# EasyEDA Pro project ProProject_Avaota Pi A_2024-03-25.epro, board 点位 (continued)
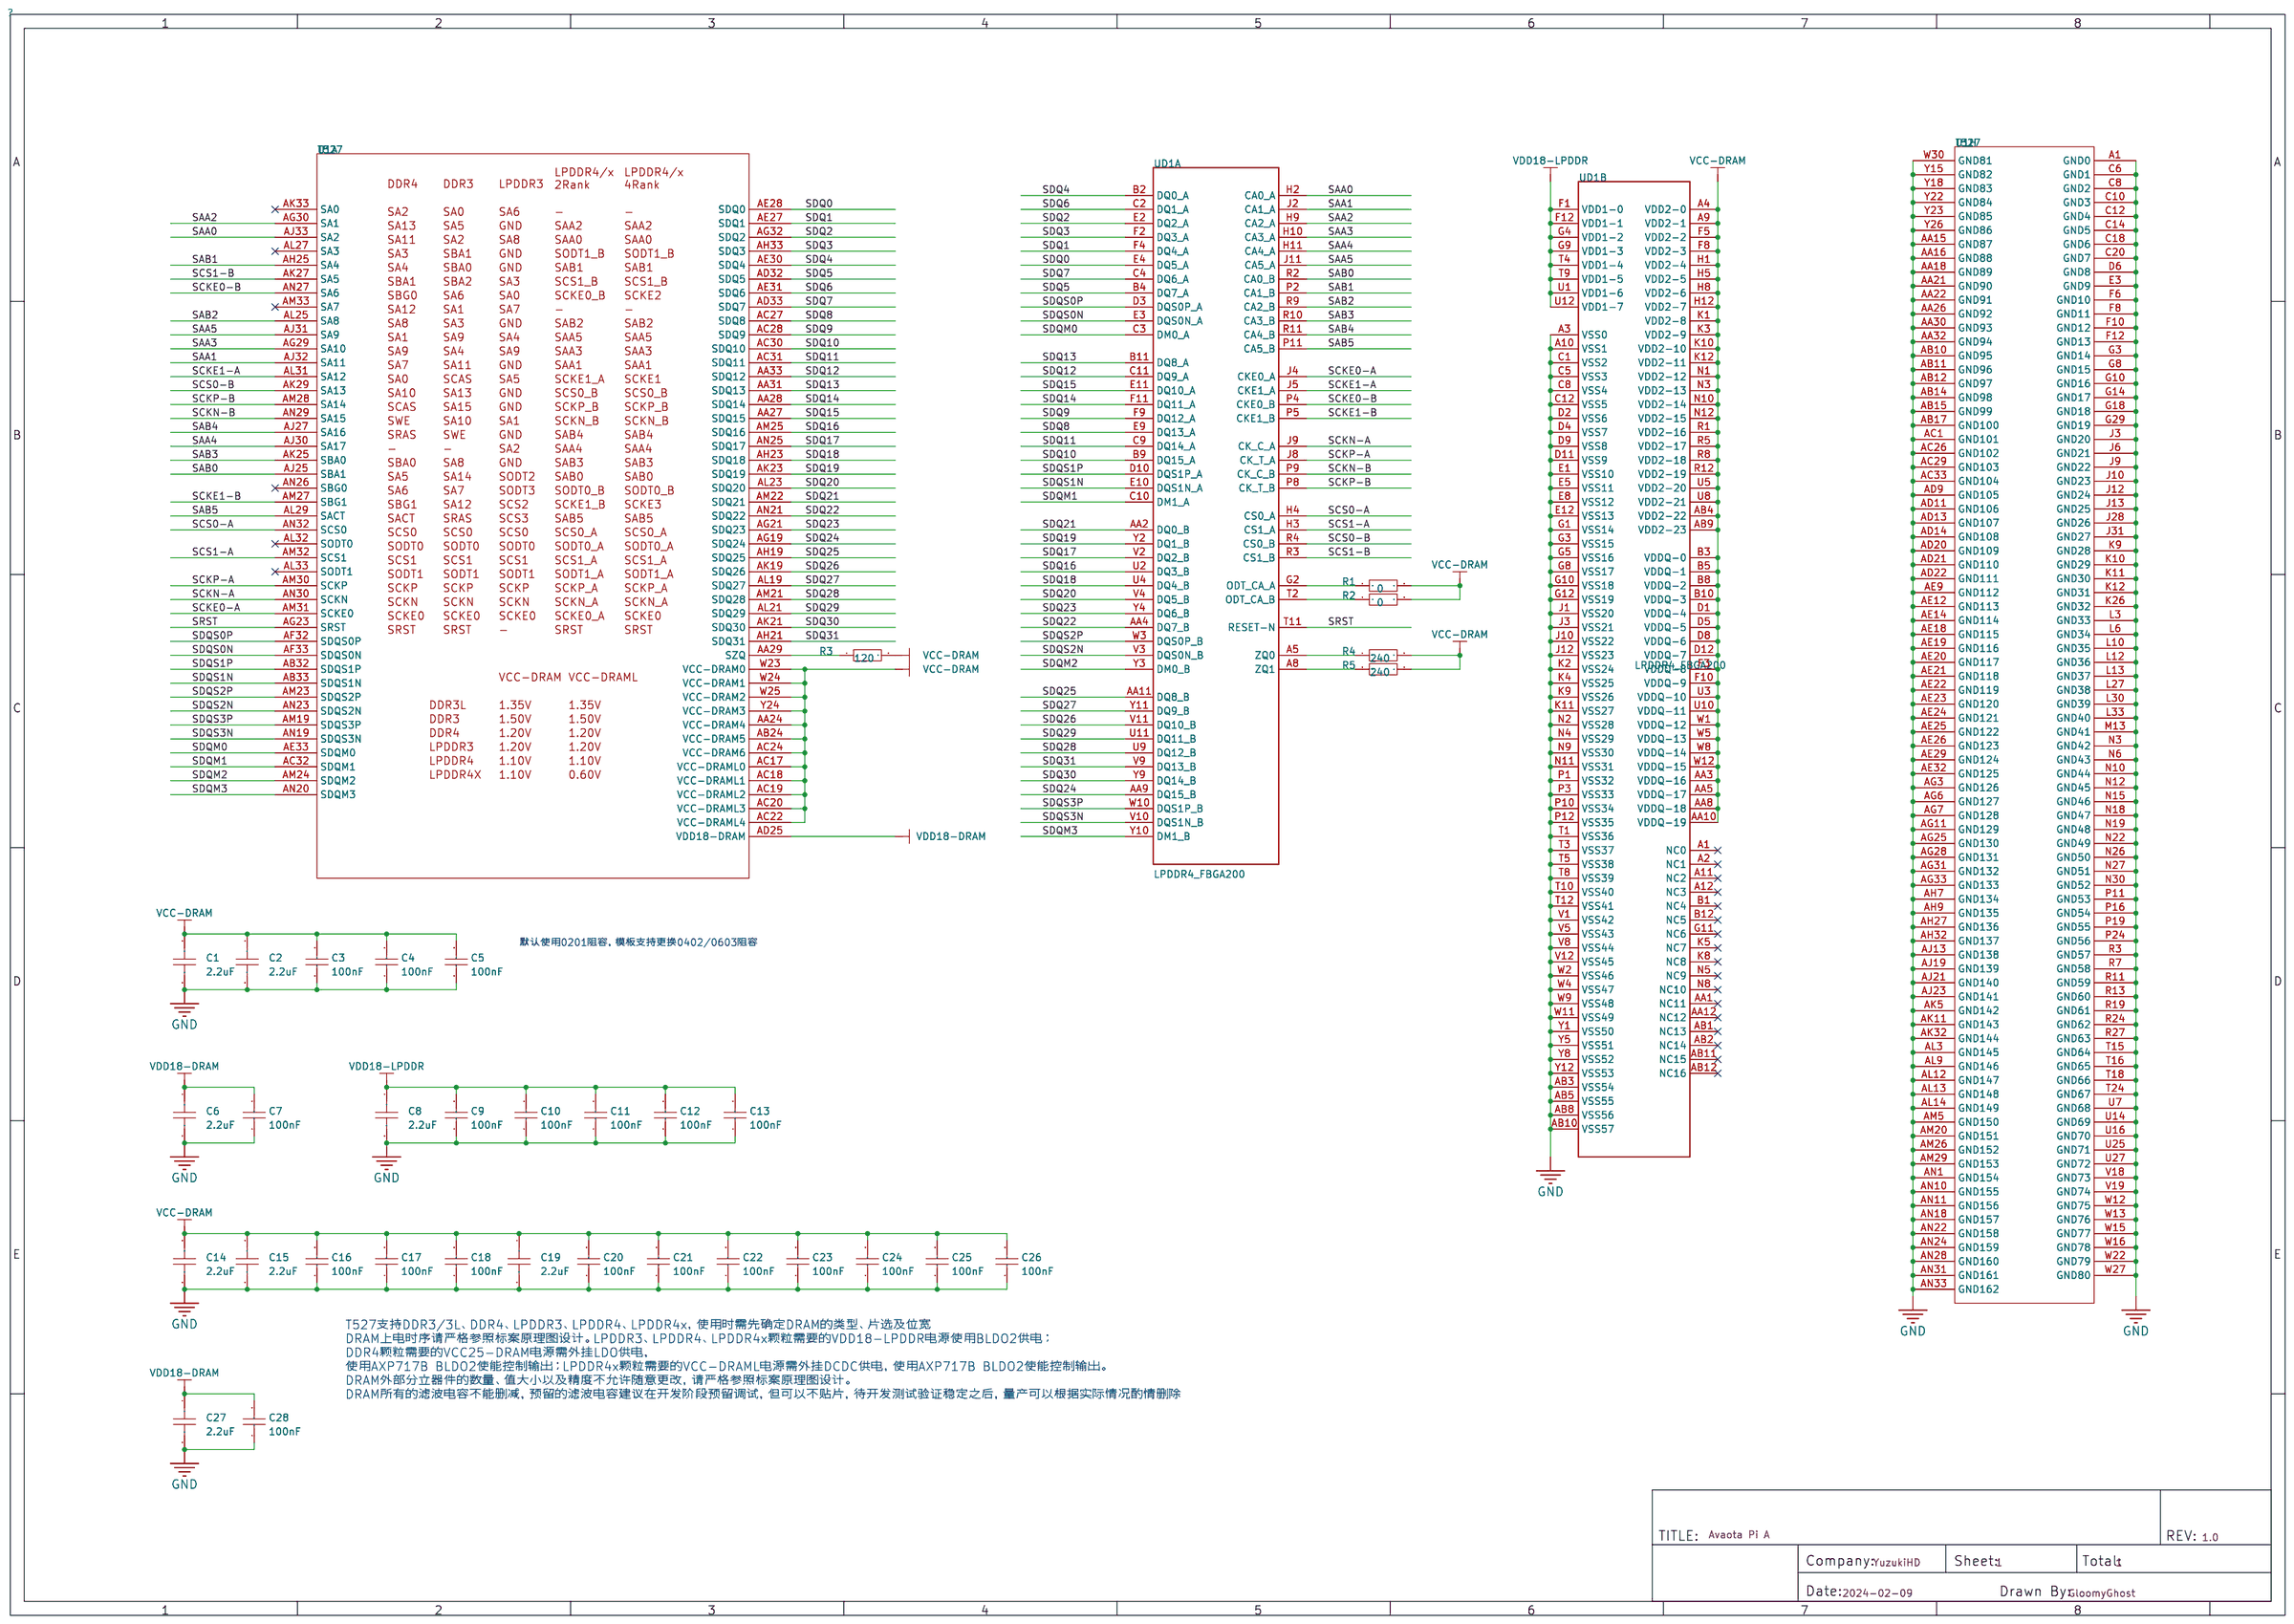
[diagram p0: schematic sheet]
## Routing (per net, layer and track width the routed paths; a pad name or vN(x,y) marks a point on that pad's centre or on a via; arc(x,y) is an arc through that point) (continued)
PE1: length 50.3
  Top Layer w0.076: 68.44,54.64 68.69,54.9 70.34,54.89 70.48,55.04
  Top Layer w0.102: v3(72.67,57.2) 72.64,57.2 70.48,55.04
  VCC w0.102: 33.3,70.69 33.32,70.69 37.49,66.52 52.5,66.52 57.05,61.98 61.29,61.98 64.8,58.47 66.19,58.47 67.18,57.48 71.12,57.48 71.22,57.58 72.29,57.58 v3(72.67,57.2)
PE2: length 52.9
  Top Layer w0.102: U14.E5 v3(67.95,54.65)
  Inner5 w0.102: 23.14,70.69 25.04,68.78 26.24,68.78 27.99,67.03 53.26,67.03 57.94,62.36 59.77,62.36 64.26,57.86 64.26,57.25 65.68,55.83 67.23,55.83 67.59,55.47 67.59,54.87 67.78,54.68 67.93,54.68 v3(67.95,54.65)
PE3: length 55.1
  Top Layer w0.102: U14.E4 v3(67.95,55.15)
  Inner5 w0.102: H1.16 25.03,72.58 24.88,72.58 24.46,72.16 24.46,69.75 25.04,69.16 26.39,69.16 28.19,67.36 53.47,67.36 58.14,62.69 60.02,62.69 64.59,58.12 64.59,57.33 65.76,56.16 67.44,56.16 67.95,55.65 v3(67.95,55.15)
PE4: length 56.9
  Top Layer w0.076: 70.43,57.76 70.24,57.76 69.18,56.71 69.18,56 69.08,55.89 68.84,55.89 68.69,55.75 68.69,55.39 68.44,55.14
  Top Layer w0.102: 70.43,57.76 70.69,57.76 71.5,58.57 v3(71.5,58.6)
  Inner5 w0.102: 25.68,70.69 25.68,70.46 28.45,67.69 53.64,67.69 57.53,63.81 59.51,63.81 65.71,57.61 70.51,57.61 v3(71.5,58.6)
PE5: length 52.3
  Top Layer w0.076: 70.08,55.5 69.97,55.4 69.19,55.4 68.94,55.14
  Top Layer w0.102: v3(71.58,57.2) 71.58,57 70.08,55.5
  VCC w0.102: H1.22 33.3,73.15 32.03,71.88 32.03,69.98 35.81,66.19 52.3,66.19 56.85,61.65 61.11,61.65 64.62,58.14 66.01,58.14 67.01,57.15 71.53,57.15 v3(71.58,57.2)
PE6: length 50.9
  Top Layer w0.076: 70.15,55.14 69.44,55.14
  Top Layer w0.102: v3(72.14,57.2) 72.14,57.12 70.15,55.14
  VCC w0.102: v3(72.14,57.2) 72.14,57.15 71.81,56.82 66.88,56.82 65.84,57.86 64.36,57.86 60.96,61.27 56.77,61.27 52.17,65.86 35.53,65.86 30.76,70.64 30.76,70.69
PE7: length 52
  Top Layer w0.102: v3(72.62,58.62) 71.96,57.96 71.78,57.96 71.22,57.4 71.22,57.05 69.82,55.65 U14.A2
  VCC w0.102: v3(72.62,58.62) 72.62,58.34 72.11,57.84 71.07,57.84 71.02,57.79 67.36,57.79 66.37,58.78 65,58.78 61.47,62.31 57.2,62.31 52.65,66.85 37.69,66.85 34.62,69.93 34.62,72.03 35.81,73.23 H1.24
PE8: length 46.5
  Top Layer w0.076: 70,56.24 69.65,55.89 69.31,55.89 69.07,55.64 68.94,55.64
  Top Layer w0.102: v3(72.06,58.6) 72.06,58.51 71.82,58.27 71.68,58.27 70.89,57.48 70.89,57.12 70,56.24
  VCC w0.102: 35.84,70.69 35.84,70.23 38.81,67.26 52.81,67.26 57.38,62.69 61.59,62.69 65.2,59.08 66.5,59.08 67.49,58.09 71.55,58.09 v3(72.06,58.6)
PE9: length 56.6
  Top Layer w0.102: v3(70.94,58.6) 70.94,58.52 70.46,58.04 70.21,58.04 68.94,56.77 68.94,56.14
  Inner5 w0.102: v3(70.94,58.6) 70.23,57.89 66.07,57.89 59.72,64.24 57.63,64.24 53.85,68.02 28.63,68.02 26.97,69.67 26.97,71.93 28.22,73.18 H1.18
PE10: length 39.4
  Top Layer w0.076: 68.83,56.94 68.69,56.8 68.69,56.01 68.44,55.76 68.44,55.64
  Top Layer w0.115: 68.83,56.94 68.83,57.22 69.91,58.29 70.07,58.29 70.37,58.6 v3(70.41,58.6)
  Inner5 w0.102: 40.92,70.69 43.26,68.35 54.81,68.35 58.06,65.1 59.49,65.1 60.22,64.36 61.32,64.36 61.52,64.16 61.52,62.97 66.32,58.17 69.98,58.17 v3(70.41,58.6)
PE11: length 59.8
  Top Layer w0.102: v3(65.95,53.15) U14.J7
  Inner5 w0.102: 15.52,70.69 18.52,67.69 25.81,67.69 27.48,66.01 52.58,66.01 57.2,61.39 59.23,61.39 60.55,60.07 60.55,58.37 61.37,57.56 62.59,57.56 65.35,54.79 65.35,53.7 65.91,53.15 v3(65.95,53.15)
PE12: length 44.7
  Top Layer w0.102: v3(69.8,58.62) 68.5,57.33 68.5,56.21 U14.C1
  VCC w0.102: v3(69.8,58.62) 69.57,58.39 67.72,58.39 66.67,59.44 65.41,59.44 61.77,63.07 59.72,63.07 58.95,63.83 56.79,63.83 52.96,67.67 38.86,67.67 37.13,69.39 37.13,71.98 H1.26
PE13: length 55.2
  Top Layer w0.254: U14.G6 v3(66.95,54.15)
  Inner5 w0.102: 20.6,70.69 20.6,70.56 23.09,68.07 25.96,68.07 27.69,66.35 52.78,66.35 57.45,61.67 59.44,61.67 60.86,60.25 60.86,58.57 61.54,57.89 62.69,57.89 65.48,55.09 66.09,55.09 66.42,54.76 66.42,54.31 66.57,54.15 v3(66.95,54.15)
PE14: length 61.7
  Top Layer w0.102: v3(64.95,53.15) U14.L7
  Inner5 w0.102: v3(64.95,53.15) 64.57,53.53 64.57,54.08 64.31,54.33 64.31,55.42 62.48,57.25 61.16,57.25 60.25,58.17 60.25,59.89 59.06,61.09 57.01,61.09 52.41,65.68 27.25,65.68 25.63,67.31 16.36,67.31 12.98,70.69
PE15: length 63.1
  Top Layer w0.102: v3(63.95,53.15) U14.N7
  Inner5 w0.102: 10.44,70.69 10.44,70.36 13.84,66.95 25.43,66.95 27,65.38 45.03,65.38 49.63,60.78 55.68,60.78 56.29,60.17 57.73,60.17 61.52,56.39 62.86,56.39 63.96,55.3 63.96,54.28 64.31,53.92 64.31,53.34 64.12,53.15 v3(63.95,53.15)
PGAOUT0: length 6.5
  Top Layer w0.152: v3(61.95,52.65) 61.45,52.65 U14.U8
  Bottom Layer w0.076: v3(61.95,52.65) 62.56,53.26
  Bottom Layer w0.152: 62.56,53.26 62.59,53.29 62.59,55.98 62.18,56.39 60.86,56.39 60.71,56.24 R26.1
PGAOUT1: length 4
  Bottom Layer w0.152: R27.1 61.76,55.21 61.44,54.89 v3(61.44,51.65)
PHYRSTB0: length 46.9
  Top Layer w0.127: U14.D16 v3(67.94,49.15) ; U12.12 v3(70.39,21.03) 70.93,21.03 R90.2
  内层2 w0.102: v3(67.94,49.15) 69.32,49.15 70.05,49.89 72.42,49.89 72.8,50.27 74.63,50.27 74.88,50.01 76.45,50.01 79.45,47.02 79.45,29.46 73.58,23.6 73.58,21.64 72.97,21.03 72.01,21.03 72.01,21.03 v3(70.39,21.03)
PHYRSTB1: length 71.3
  Top Layer w0.102: v3(89.53,51.23) 89.53,51.26 88.62,52.17 88.47,52.17 88.04,52.6 88.04,57.99 83.85,62.18 68.41,62.18 65.94,59.71 65.94,57.3 65.58,56.95 65.58,56.29 U14.J1
  Top Layer w0.152: U13.12 88.99,20.89 R108.2
  内层2 w0.102: v3(88.65,20.8) 89.31,20.8 90.14,21.64 90.14,22.5 89.99,22.66 89.99,23.14 90.27,23.42 90.6,23.42 91.52,24.33 91.52,25.25 90.07,26.7 90.07,28.19 89.28,28.98 89.28,50.98 v3(89.53,51.23)
PMU-SCK: length 72.3
  Top Layer w0.102: U14.AN6 53.34,53.75 52.53,53.75 51.49,54.79 51.49,55.6 50.39,56.69 v1(37.36,56.69)
  Top Layer w0.152: R11.2 5.18,49.05 v3(5.16,49.07) 5.31,49.23 U4.52 ; v3(12.32,45.31) 12.75,44.88 13.03,44.88 13.13,44.98 14.78,44.98 15.09,44.68 15.09,44.06 U5.6
  Bottom Layer w0.102: v1(37.36,56.69) 36.55,56.69 35.86,56.01 14.4,56.01 12.47,54.08 12.47,50.06 11.1,48.69 6.26,48.69 5.65,49.3 5.38,49.3 v3(5.16,49.07) 5.16,48.9 5.82,48.23 5.82,46.05 6.93,44.93 11.94,44.93 v3(12.32,45.31)
PMU-SDA: length 75.2
  Top Layer w0.076: 53.43,54.14 53.44,54.14
  Top Layer w0.102: v1(36.75,57.07) 37.57,57.07 37.72,56.92 50.52,56.92 51.71,55.73 51.71,54.86 52.63,53.95 53.25,53.95 53.43,54.14 U14.AN5
  Top Layer w0.152: v3(12.85,45.31) 12.9,45.26 14.88,45.26 15.45,44.7 U5.5 ; R12.2 5.71,48.16 5.56,48.31 5.56,48.77 5.69,48.9 6.12,48.9 6.2,48.97 6.2,49.56 6.12,49.63 5.15,49.63 v3(5.13,49.61)
  Bottom Layer w0.102: v1(36.75,57.07) 36.42,57.07 35.66,56.31 13.51,56.31 12.24,55.04 12.24,50.24 10.97,48.97 6.35,48.97 5.71,49.61 v3(5.13,49.61) 4.8,49.28 4.8,48.92 5.56,48.16 5.56,45.92 6.78,44.7 12.24,44.7 v3(12.85,45.31)
PS: length 30.3
  Top Layer w0.203: C17.1 12.75,51.77 12.49,52.03 U4.20 11.59,52.02 v3(11.05,52.02) ; U4.47 6.32,51.23 v3(6.38,51.28) ; C12.1 12.62,54.51 12.14,54.03 U4.25 11.6,54.03 v3(11.05,54.03) ; 5.73,52.43 6.32,52.43 v3(6.38,52.38) ; v3(6.38,52.86) 6.35,52.83 U4.43 ; v3(6.38,50.81) 6.36,50.83 U4.48 ; U5.20 17.66,44.16 v3(17.65,44.17) ; U5.2 16.65,44.96 v3(16.79,45.1) ; U5.17 18.04,42.61 18.19,42.47 v3(18.19,41.81) ; C55.1 12.78,48.97 12.4,49.35 12.4,49.56 11.92,50.03 U4.15 11.04,50.03 v3(11.02,50.01) ; v3(9.32,54.15) 9.26,54.21 U4.31 9.26,54.95 v3(8.99,55.22) 8.86,55.09 U4.32 8.86,54.23 v3(8.79,54.15)
  Top Layer w0.254: U4.9 v3(9.66,49.43)
  Top Layer w0.381: C70.2 17.91,45.03 17.91,44.42 v3(17.65,44.17)
  Top Layer w0.406: C284.2 17.84,39.92 18.19,40.26 v3(18.19,41.81)
  Top Layer w0.508: C284.2 C283.2
  Bottom Layer w0.102: v3(11.02,50.01) C46.1
  Bottom Layer w0.381: v3(11.05,54.03) 11.1,53.98 11.1,53.31 ; v3(9.66,49.43) 9.67,49.43 C30.1 ; v3(11.05,52.02) 11.1,52.07 11.1,52.43
  Bottom Layer w0.508: 11.05,51.35 v3(11.05,52.02) ; v3(9.32,54.15) 9.32,55.28 C285.2 ; 5.89,52.38 v3(6.38,52.38) ; v3(6.38,51.28) 6.02,51.28 C79.2 ; v3(6.38,50.81) 6.13,51.05 C79.2 ; v3(8.79,54.15) 8.79,55.13 C286.2 ; C79.2 C29.1 5.79,52.83 5.82,52.86 v3(6.38,52.86) 6.5,52.98 C26.1
PWRON: length 21.7
  Top Layer w0.152: C11.1 8.46,48.88 U4.6 ; v1(4.32,63.53) 4.32,64.52 3.49,65.34 C97.2
  Top Layer w0.203: U4.6 8.46,49.31 v3(8.66,49.5)
  Top Layer w0.254: C97.2 R23.2
  Inner5 w0.152: v3(8.66,49.5) 7.9,50.27 7.9,53.29 7.57,53.62 7.01,53.62 3.91,56.72 3.91,63.12 v1(4.32,63.53)
RF: length 3.7
  Top Layer w0.127: R72.1 C244.2 15.68,64.17 15.72,64.2
RGMII0-CLKIN: length 47.9
  Top Layer w0.076: 70.56,48.18 70.33,48.18 70.26,48.11 69.99,48.11 69.78,47.9 68.69,47.89 68.44,48.14
  Top Layer w0.102: v3(74.04,49.28) 72.95,48.18 70.56,48.18
  Top Layer w0.127: U12.35 v3(63.35,22.63)
  内层2 w0.102: v3(63.35,22.63) 63.52,22.45 71.7,22.45 72.31,23.06 72.31,24 78.51,30.2 78.51,46.51 75.84,49.17 74.14,49.17 v3(74.04,49.28)
RGMII0-MDC: length 43.5
  Top Layer w0.076: 69.9,48.53 69.9,48.54 ; 69.9,48.53 69.67,48.3 69.14,48.3 69.04,48.39 68.69,48.39 68.44,48.64
  Top Layer w0.102: v3(72.85,49.3) 72.24,48.69 70.04,48.69 69.88,48.51 ; v3(72.42,21.49) 72.35,21.43 U12.13
  内层2 w0.102: v3(72.85,49.3) 73.2,49.66 74.24,49.66 74.47,49.43 76.05,49.43 78.82,46.66 78.82,29.97 72.72,23.88 72.72,21.79 v3(72.42,21.49)
RGMII0-MDIO: length 44.1
  Top Layer w0.076: 71.98,49 71.91,48.92 69.22,48.92 U14.B16
  Top Layer w0.102: 71.98,49 v3(72.29,49.3)
  Top Layer w0.127: U12.14 70.91,21.83 R83.2 70.93,21.98 71.23,22.28 72.26,22.28 72.72,21.82 v3(73.18,21.82)
  内层2 w0.102: v3(72.29,49.3) 72.92,49.94 74.47,49.94 74.7,49.71 76.25,49.71 79.12,46.84 79.12,29.69 73.1,23.67 73.1,21.9 v3(73.18,21.82)
RGMII0-RXCK: length 42.7
  Top Layer w0.076: 68.94,49.64 69.1,49.64 69.34,49.4 69.54,49.4 69.84,49.7 70.29,49.7 v3(70.66,49.33)
  Top Layer w0.127: v3(66.19,26.76) 66.19,26.54 66,26.35 U12.27
  内层2 w0.102: v3(66.19,26.76) 66.42,26.53 66.42,25.2 67.39,24.23 70.51,24.23 77.27,30.99 77.27,45.92 75.16,48.03 71.96,48.03 v3(70.66,49.33)
RGMII0-RXCTL: length 42.2
  Top Layer w0.127: U14.D18 v3(67.94,48.15) ; v3(66.75,26.76) 66.75,26.49 66.4,26.14 U12.26
  内层2 w0.102: v3(66.75,26.76) 66.75,25.3 67.49,24.56 70.28,24.56 76.91,31.19 76.91,45.87 75.11,47.68 71.75,47.68 70.79,48.64 68.43,48.64 v3(67.94,48.15)
RGMII0-RXD0: length 41.5
  Top Layer w0.127: U14.E18 v3(67.44,48.15) ; U12.25 66.8,25.96 67.34,26.49 v3(67.34,26.76)
  内层2 w0.102: v3(67.44,48.15) 67.44,47.93 67.59,47.78 68.1,47.78 68.61,48.29 70.69,48.29 71.6,47.37 74.93,47.37 76.58,45.72 76.58,31.39 70.03,24.84 67.64,24.84 67.11,25.37 67.11,26.39 67.34,26.62 v3(67.34,26.76)
RGMII0-RXD1: length 40.5
  Top Layer w0.127: U12.24 67.2,25.8 67.96,26.56 v3(67.96,26.76) ; U14.F18 v3(66.94,48.15)
  内层2 w0.102: v3(66.94,48.15) 66.94,48.02 67.42,47.54 68.34,47.54 68.76,47.96 70.56,47.96 71.48,47.04 74.78,47.04 76.25,45.57 76.25,31.62 69.75,25.12 67.87,25.12 67.46,25.53 67.46,26.26 v3(67.96,26.76)
RGMII0-RXD2: length 48.8
  Top Layer w0.127: v3(68.55,26.76) 68.55,26.59 67.6,25.64 67.6,24.93 ; U14.D14 v3(67.94,50.15)
  内层4 w0.102: v3(67.94,50.15) 68.06,50.15 70.03,48.18 78.21,48.18 80.57,45.82 80.57,28.8 76.78,25.02 69.77,25.02 68.55,26.24 v3(68.55,26.76)
RGMII0-RXD3: length 48.1
  Top Layer w0.127: v3(67.44,50.15) U14.E14 ; U12.22 68,25.48 69.19,26.67 v3(69.19,26.76)
  内层4 w0.102: v3(69.19,26.76) 68.94,26.5 68.94,26.29 69.93,25.3 76.68,25.3 80.29,28.91 80.29,45.64 78.03,47.9 69.9,47.9 68.05,49.76 67.84,49.76 v3(67.44,50.15)
RGMII0-TXCK: length 50.4
  Top Layer w0.102: U14.G12 66.42,50.62 v3(66.42,50.17) ; v3(76.84,23.93) 76.45,24.31 75.26,24.31 74.7,23.75 73.03,23.75 72.29,24.49 69.82,24.49 69.57,24.23 U12.20
  内层2 w0.076: v3(66.42,50.17) 66.78,50.52 68.07,50.52 68.43,50.17 68.94,50.17 69.04,50.27
  内层2 w0.102: 69.04,50.27 69.49,50.72 71.91,50.72 72.42,51.23 75.16,51.23 75.41,50.98 76.99,50.98 80.44,47.52 80.44,28.78 76.84,25.17 v3(76.84,23.93)
RGMII0-TXCTL: length 48.6
  Top Layer w0.102: v3(76.2,23.9) 75.31,23.9 74.83,23.42 72.85,23.42 72.09,24.18 69.98,24.18 69.62,23.83 U12.19
  Top Layer w0.127: U14.F14 v3(66.94,50.15)
  内层2 w0.102: v3(66.94,50.15) 67.36,49.73 69.01,49.73 69.7,50.42 72.03,50.42 72.52,50.9 74.96,50.9 75.21,50.65 76.81,50.65 80.11,47.35 80.11,29.03 76.45,25.37 76.45,24.16 v3(76.2,23.9)
RGMII0-TXD0: length 47.5
  Top Layer w0.102: U12.18 69.76,23.43 70.16,23.83 71.98,23.83 72.75,23.06 75.03,23.06 75.46,23.5 v3(75.62,23.5)
  Top Layer w0.127: U14.E16 v3(67.44,49.15)
  内层2 w0.102: v3(75.62,23.5) 75.62,23.9 76.1,24.38 76.1,25.55 79.78,29.24 79.78,47.19 76.63,50.34 75.03,50.34 74.78,50.6 72.62,50.6 72.19,50.17 69.9,50.17 69.24,49.5 67.79,49.5 v3(67.44,49.15)
RGMII0-TXD1: length 39.9
  Top Layer w0.076: 68.94,48.14 69.02,48.07 69.71,48.07 70.08,48.44 70.43,48.44
  Top Layer w0.102: v3(73.46,49.3) 72.59,48.44 70.43,48.44 ; v3(70.16,23.11) 70.07,23.03 U12.17
  内层2 w0.102: v3(73.46,49.3) 73.86,48.9 75.64,48.9 78.23,46.3 78.23,30.4 71.96,24.13 71.96,23.17 71.65,22.86 70.41,22.86 v3(70.16,23.11)
RGMII0-TXD2: length 37.5
  Top Layer w0.076: 69.44,49.64 69.71,49.91 70.36,49.91 70.62,49.66 70.87,49.66 v3(71.2,49.33)
  Top Layer w0.102: U12.16 70.25,22.63 v3(70.97,23.34)
  内层2 w0.102: v3(71.2,49.33) 72.19,48.34 75.29,48.34 77.6,46.03 77.6,30.79 71.2,24.38 71.2,23.57 v3(70.97,23.34)
RGMII0-TXD3: length 39
  Top Layer w0.102: v3(71.55,23.34) 71.55,23.27 70.51,22.23 U12.15 ; v3(71.73,49.33) 71.2,49.86 70.76,49.86 70.51,50.11 68.97,50.11 U14.B13
  内层2 w0.102: v3(71.73,49.33) 72.44,48.62 75.44,48.62 77.93,46.13 77.93,30.61 71.55,24.23 v3(71.55,23.34)
RGMII1-CLKIN: length 59
  Top Layer w0.076: 67.44,55.64 67.7,55.91 67.7,57.71 68.3,58.3 68.3,58.32
  Top Layer w0.102: 68.3,58.32 69.8,59.82 81.64,59.82 84.07,57.38 84.07,55.32 84.28,55.12 84.28,54.36 83.97,54.05 83.49,54.05 v3(83.16,53.72)
  Top Layer w0.152: U13.35 v3(81.53,22.49)
  内层2 w0.102: v3(83.16,53.72) 83.16,52.12 83.74,51.54 83.74,48.34 84.56,47.52 84.56,27.89 83.87,27.2 83.87,26.44 84.25,26.06 84.25,25.21 v3(81.53,22.49)
RGMII1-MDC: length 71.2
  Top Layer w0.076: 65.94,55.64 66.01,55.71 66.01,56.4 66.27,56.66 66.27,58.01 66.18,58.09 66.18,58.49 66.24,58.56
  Top Layer w0.102: v3(88.95,51.23) 88.52,51.66 88.44,51.66 87.68,52.43 87.68,57.79 83.59,61.87 68.63,61.87 66.25,59.5 66.25,58.55 ; v3(90.45,22.94) 90.12,22.61 90.12,21.64 89.77,21.29 U13.13
  内层2 w0.102: v3(90.45,22.94) 90.7,22.94 91.9,24.13 91.9,25.43 90.37,26.95 90.37,28.35 89.61,29.11 89.61,50.75 89.92,51.05 89.92,51.38 89.66,51.64 89.41,51.64 89.26,51.49 89.2,51.49 v3(88.95,51.23)
RGMII1-MDIO: length 68
  Top Layer w0.076: 65.94,55.14 66.19,55.4 66.19,56.32 66.43,56.56 66.43,58.33 66.51,58.41 66.51,58.98 66.55,59.01 ; 66.55,59.01 66.55,59.15
  Top Layer w0.102: R101.2 89.04,22.19 v3(89.33,22.48) ; v3(88.37,51.23) 87.33,52.27 87.33,57.58 83.34,61.57 68.86,61.57 66.55,59.27 66.55,59.15
  Top Layer w0.152: R101.2 89.04,21.69 U13.14
  内层2 w0.102: v3(89.33,22.48) 89.71,22.86 89.71,23.42 90.04,23.75 90.37,23.75 91.11,24.49 91.11,25.12 89.66,26.57 89.66,28.14 88.9,28.91 88.9,50.7 v3(88.37,51.23)
RGMII1-RXCK: length 60.2
  Top Layer w0.102: U14.J5 v3(65.95,54.15)
  Top Layer w0.152: v3(84.28,26.61) 84.16,26.49 84.16,24.79
  内层2 w0.102: v3(84.28,26.61) 84.28,27.03 84.88,27.63 84.88,47.7 84.1,48.49 84.1,51.74 83.57,52.27 83.57,53.87 82.98,54.46 82.98,54.97 83.36,55.35 83.74,55.35 84.33,55.93 84.33,57.63 82.17,59.79 68.53,59.79 67.56,58.83 67.56,53.87 67.26,53.57 66.7,53.57 66.12,54.15 v3(65.95,54.15)
RGMII1-RXCTL: length 54.5
  Top Layer w0.076: 67.75,58.05 67.44,57.74 67.44,56.54
  Top Layer w0.102: 67.76,58.05 67.76,58.15 69.7,60.1 81.91,60.1 84.45,57.56 84.45,55.52 84.63,55.35 84.63,54.25 84.02,53.65 v3(84.02,52.48) ; 67.44,56.15 67.44,56.54
  Top Layer w0.152: v3(84.81,26.61) 84.81,26.34 84.56,26.09 84.56,24.79
  内层2 w0.102: v3(84.81,26.61) 84.81,27.08 85.19,27.46 85.19,47.93 84.48,48.64 84.48,52.02 v3(84.02,52.48)
RGMII1-RXD0: length 57.5
  Top Layer w0.076: 68.4,57.63 68.19,57.42 68.19,55.9 67.94,55.64
  Top Layer w0.102: 68.4,57.63 68.4,57.71 69.9,59.21 76.64,59.21 76.74,59.11 76.74,58.85 76.84,58.75 77.02,58.75 77.12,58.85 77.12,59.11 77.22,59.21 77.4,59.21 77.5,59.11 77.5,58.85 77.6,58.75 77.78,58.75 77.88,58.85 77.88,59.11 77.98,59.21 78.16,59.21 78.26,59.11 78.26,58.85 78.36,58.75 78.54,58.75 78.64,58.85 78.64,59.11 78.74,59.21 78.92,59.21 79.02,59.11 79.02,58.85 79.12,58.75 79.3,58.75 79.4,58.85 79.4,59.11 79.51,59.21 79.68,59.21 79.79,59.11 79.79,58.85 79.89,58.75 80.06,58.75 80.17,58.85 80.17,59.11 80.27,59.21 80.45,59.21 80.55,59.11 80.55,58.85 80.65,58.75 80.83,58.75 80.93,58.85 80.93,59.11 81.03,59.21 81.23,59.21 83.39,57.05 83.39,56.44 83.29,56.33 83.03,56.33 82.93,56.23 82.93,56.05 83.03,55.95 83.29,55.95 83.39,55.85 83.39,55.67 83.29,55.57 83.03,55.57 82.93,55.47 82.93,55.29 83.03,55.19 83.29,55.19 83.39,55.09 v3(83.39,54.64)
  Top Layer w0.152: 84.96,24.79 84.96,25.9 85.37,26.31 v3(85.37,26.61)
  内层2 w0.102: v3(83.39,54.64) 83.41,54.64 83.92,54.13 83.92,53.19 84.81,52.3 84.81,48.87 85.5,48.18 85.5,27.28 85.37,27.15 v3(85.37,26.61)
RGMII1-RXD1: length 52.5
  Top Layer w0.076: 67.94,56.14 68.01,56.22 68.01,57.58
  Top Layer w0.102: 68.01,57.58 68.01,57.64 69.89,59.51 81.41,59.51 83.72,57.2 83.72,54.89 v3(83.92,54.69)
  Top Layer w0.152: 85.36,24.79 85.36,25.79 85.95,26.39 v3(85.95,26.61)
  内层2 w0.102: v3(85.95,26.61) 85.95,27.18 85.83,27.31 85.83,48.41 85.14,49.1 85.14,52.5 84.25,53.39 84.25,54.36 v3(83.92,54.69)
RGMII1-RXD2: length 60.4
  Top Layer w0.102: v3(65.95,54.65) U14.J4
  Top Layer w0.152: v3(86.51,26.61) 86.51,26.54 85.76,25.79 85.76,24.79
  内层2 w0.102: v3(65.95,54.65) 66.8,53.8 67.11,53.8 67.31,54 67.31,55.7 67.21,55.8 67.21,59.03 68.33,60.15 82.32,60.15 84.66,57.81 84.66,53.49 85.47,52.68 85.47,49.25 86.13,48.59 86.13,27.48 86.51,27.1 v3(86.51,26.61)
RGMII1-RXD3: length 59.7
  Top Layer w0.102: U14.G5 v3(66.95,54.65)
  Top Layer w0.152: v3(87.07,26.61) 87.07,26.54 86.16,25.63 86.16,24.79
  内层2 w0.102: v3(87.07,26.61) 87.07,27.05 86.46,27.66 86.46,48.84 85.85,49.45 85.85,52.86 85.04,53.67 85.04,57.96 82.47,60.53 68.17,60.53 66.9,59.26 66.9,55.65 66.57,55.32 66.57,55.03 v3(66.95,54.65)
RGMII1-TXCK: length 60.4
  Top Layer w0.076: 66.44,56.14 66.44,56.25 66.6,56.41 66.6,58.15 66.77,58.32 66.77,58.46
  Top Layer w0.102: 66.77,58.46 66.77,59 69.03,61.27 83.03,61.27 86.94,57.35 86.94,53.95 v3(86.18,53.19) ; 87.26,24.09 87.59,24.09 87.76,24.26 v3(87.76,25.1)
  内层2 w0.102: v3(86.18,53.19) 86.23,53.14 86.23,49.58 86.82,49 86.82,27.91 87.5,27.23 87.5,25.35 v3(87.76,25.1)
RGMII1-TXCTL: length 60.4
  Top Layer w0.076: 67.03,58.52 67.03,58.29 66.78,58.04 66.78,56.32 66.69,56.23 66.69,55.89 66.44,55.64
  Top Layer w0.102: U13.19 87.72,23.69 88.32,24.28 v3(88.32,25.1) ; v3(86.51,54.15) 86.47,54.15 86.59,54.27 86.59,57.12 82.75,60.96 69.21,60.96 67.03,58.78 67.03,58.52
  内层2 w0.102: v3(86.51,54.15) 86.51,53.52 86.61,53.42 86.61,49.78 87.15,49.25 87.15,28.07 87.83,27.38 87.83,25.58 v3(88.32,25.1)
RGMII1-TXD0: length 59.9
  Top Layer w0.076: 67.53,58.36 67.53,58.08 67.24,57.78 67.24,56.57 67.19,56.52 67.19,55.89 66.94,55.64
  Top Layer w0.102: 67.52,58.34 69.58,60.4 82.17,60.4 84.81,57.76 84.81,55.88 85.39,55.3 v3(85.42,55.3) ; v3(88.87,25.1) 88.87,24.31 87.86,23.29 87.26,23.29
  内层2 w0.102: v3(85.42,55.3) 85.72,54.99 86.56,54.99 86.97,54.58 86.97,49.96 87.5,49.43 87.5,28.22 88.16,27.56 88.16,25.81 v3(88.87,25.1)
RGMII1-TXD1: length 61.1
  Top Layer w0.076: 66.94,56.14 67.01,56.22 67.01,57.94 67.28,58.21 67.28,58.56 67.3,58.57
  Top Layer w0.102: v3(89.46,25.1) 89.46,24.34 88.01,22.89 U13.17 ; 67.3,58.57 69.4,60.68 82.45,60.68 85.19,57.94 85.19,56.08 85.55,55.73 85.93,55.73 v3(86.13,55.52)
  内层2 w0.102: v3(86.13,55.52) 86.39,55.27 86.77,55.27 87.33,54.71 87.33,50.19 87.86,49.66 87.86,28.37 88.52,27.71 88.52,26.04 v3(89.46,25.1)
RGMII1-TXD2: length 66.4
  Top Layer w0.102: v3(90.02,25.1) 90.02,24.38 88.12,22.49 U13.16 ; v3(64.95,54.15) U14.L5
  内层2 w0.102: v3(90.02,25.1) 88.9,26.21 88.9,27.86 88.19,28.58 88.19,49.89 87.68,50.39 87.68,54.89 86.54,56.03 86.54,57.05 82.6,60.99 68.07,60.99 65.81,58.73 65.81,57.33 65.33,56.85 65.33,54.52 v3(64.95,54.15)
RGMII1-TXD3: length 68.1
  Top Layer w0.102: U14.L4 v3(64.95,54.65) ; v3(89.31,23.14) 88.21,22.05 87.86,22.05 87.82,22.09 87.26,22.09
  内层2 w0.102: v3(64.95,54.65) 64.95,56.92 65.46,57.43 65.46,58.85 67.92,61.32 82.8,61.32 86.89,57.23 86.89,56.24 88.01,55.12 88.01,50.7 88.54,50.17 88.54,28.75 89.31,27.99 89.31,26.42 90.75,24.97 90.75,24.66 90.22,24.13 89.89,24.13 89.31,23.55 v3(89.31,23.14)
SAA0: length 16.5
  Top Layer w0.076: 55.43,40.14 55.18,40.39 55.18,40.75 54.87,41.07 v2(54.87,41.12)
  Top Layer w0.115: v2(44.78,43.74) 44.42,44.09 44.27,44.09 43.33,45.03 42.47,45.03 42.34,45.16 41.71,45.16 41.41,44.85
  Inner5 w0.115: v2(54.87,41.12) 54.79,41.05 52.42,41.05 51.43,42.04 47.27,42.04 46.48,42.82 46.2,42.82 45.28,43.74 v2(44.78,43.74)
SAA1: length 17.3
  Top Layer w0.076: 55.43,40.64 55.43,40.75 55.19,40.99 55.19,41.42 v2(54.96,41.66)
  Top Layer w0.115: v2(44.4,44.48) 44.4,44.81 43.33,45.87 42.97,45.87 42.76,45.65 42.58,45.65 42.44,45.8 42.06,45.8 41.76,45.5 41.41,45.5
  Inner5 w0.076: 54.18,41.33 54.51,41.33 54.61,41.35 v2(54.96,41.66)
  Inner5 w0.115: 54.18,41.33 53.17,41.33 52.3,42.19 51.67,42.19 51.42,42.44 47.38,42.44 46.63,43.19 46.35,43.19 45.22,44.32 44.56,44.32 44.41,44.48 v2(44.4,44.48) ; v2(54.96,41.66) 54.92,41.66
SAA2: length 23.6
  Top Layer w0.102: v2(36.17,45.18) 36.16,45.18 35.83,44.85 35.81,44.85
  Top Layer w0.115: 56.43,41.64 56.43,41.68 v2(55.98,42.14)
  Inner5 w0.076: 54.05,41.93 54.13,42.01 55.09,42.01 55.29,41.81 55.6,41.81 55.93,42.14 v2(55.98,42.14)
  Inner5 w0.115: v2(36.17,45.18) 36.24,45.11 37.62,45.11 38.12,45.62 38.63,45.62 39.01,45.24 39.01,45.02 39.13,44.91 40.51,44.91 40.68,44.74 43.56,44.74 44.08,45.26 44.66,45.26 44.88,45.05 45.54,45.05 46.66,43.93 46.94,43.93 47.66,43.21 51.61,43.21 52,42.82 52.27,42.82 52.35,42.9 52.91,42.9 53.87,41.93 54.05,41.93
SAA3: length 26.5
  Top Layer w0.115: v2(55.98,42.67) 55.98,42.65 56.43,42.19 56.43,42.14 ; v2(35.33,45.17) 35.01,44.85
  内层2 w0.076: v2(55.98,42.67) 55.98,42.75 55.7,43.02 54.07,43.02 53.87,42.82
  内层2 w0.115: 53.87,42.82 53.21,42.16 52.5,42.16 52.31,42.35 44.18,42.35 43.97,42.57 43.58,42.57 42.7,43.46 42.39,43.46 41.48,44.37 40.76,44.37 40.56,44.17 39.16,44.17 38.63,44.7 38.4,44.7 37.97,45.14 37.97,46.28 37.87,46.38 36.85,46.38 36.73,46.25 36.73,45.11 36.4,44.78 35.72,44.78 v2(35.33,45.17)
SAA4: length 24.9
  Top Layer w0.102: v2(34.59,45.26) 34.59,45.24 34.21,44.85
  Top Layer w0.115: v2(55.43,42.15) 55.43,41.64
  Inner5 w0.076: v2(55.43,42.15) 55.4,42.19 53.99,42.19
  Inner5 w0.115: 53.99,42.19 52.94,43.23 52.6,43.23 52.25,43.59 47.8,43.59 47.09,44.3 46.81,44.3 45.69,45.41 45.03,45.42 44.82,45.63 43.93,45.63 43.41,45.11 41.83,45.11 41.68,45.26 40.13,45.26 39.57,45.82 39.19,45.82 38.89,46.13 38.89,46.25 38.76,46.38 36.04,46.38 35.89,46.23 35.1,46.23 34.59,45.72 v2(34.59,45.26)
SAA5: length 29.7
  Top Layer w0.115: 55.43,41.14 55.92,41.63 v2(55.93,41.63) ; v2(34.72,46.51) 34.57,46.35 34.57,45.87 34.21,45.51 34.21,45.5
  Inner5 w0.115: v2(55.93,41.63) 56,41.63 56.34,41.96 56.34,42.85 55.88,43.31 54.3,43.31 54.05,43.56 54.05,44.14 52.7,45.49 52.47,45.49 52.09,45.87 48.02,45.87 47.6,46.29 46.97,46.29 45.39,47.87 43.47,47.87 42.67,48.67 41.68,48.67 41.35,49 41.35,49.18 41.1,49.43 40.59,49.43 40.41,49.25 39.88,49.25 39.67,49.45 39.16,49.45 38.89,49.17 37.16,49.17 35.23,47.24 35.23,47.02 v2(34.72,46.51)
SAB0: length 23.2
  Top Layer w0.115: v2(41.81,49.1) 41.51,49.4 41.41,49.4 ; 55.47,44.1 55.43,44.14 55.47,44.1 ; 55.47,44.1 v2(55.47,43.68)
  内层2 w0.076: v2(55.47,43.68) 55.47,43.56 55.12,43.21 54,43.21
  内层2 w0.115: 54,43.21 53.59,43.21 53.47,43.08 52.83,43.08 52.42,42.67 51.67,42.67 51.55,42.79 51.55,42.92 51.44,43.04 51.29,43.04 51.17,42.92 51.17,42.79 51.06,42.67 50.91,42.67 50.79,42.79 50.79,42.92 50.68,43.04 50.53,43.04 50.41,42.92 50.41,42.79 50.3,42.67 50.14,42.67 50.03,42.79 50.03,42.92 49.92,43.04 49.76,43.04 49.65,42.92 49.65,42.79 49.53,42.67 49.38,42.67 49.27,42.79 49.27,42.92 49.15,43.04 49,43.04 48.89,42.92 48.89,42.79 48.77,42.67 48.09,42.67 47.97,42.79 47.97,43.27 47.86,43.38 47.71,43.38 47.59,43.27 47.59,42.79 47.48,42.67 47.33,42.67 47.21,42.79 47.21,43.27 47.1,43.38 46.95,43.38 46.83,43.27 46.83,42.79 46.72,42.67 46.57,42.67 46.25,42.99 46.25,43.6 45.22,44.63 44.93,44.63 42.19,47.37 42.19,48.72 v2(41.81,49.1)
SAB1: length 22.6
  Top Layer w0.115: 55.93,44.14 56.01,44.07 v2(56.01,43.68) ; v2(43.71,48.29) 43.7,48.29 43.36,48.29 43.02,48.62 42.5,48.62 42.31,48.44 42.06,48.44 41.86,48.64 41.51,48.64 41.41,48.75
  内层2 w0.115: v2(43.71,48.29) 43.71,47.41 43.84,47.28 44,47.28 44.12,47.39 44.12,47.77 44.28,47.93 44.65,47.93 44.88,47.7 44.88,47.52 44.33,46.97 44.33,46.79 45.39,45.73 45.78,45.73 46.96,44.55 49.01,44.55 49.12,44.44 49.12,44.1 49.23,43.98 49.39,43.98 49.5,44.1 49.5,44.44 49.62,44.55 49.77,44.55 49.88,44.44 49.88,44.1 50,43.98 50.15,43.98 50.26,44.1 50.26,44.44 50.38,44.55 50.53,44.55 50.64,44.44 50.64,44.1 50.76,43.98 50.91,43.98 51.03,44.1 51.03,44.44 51.14,44.55 52.07,44.55 52.52,44.09 55.59,44.09 v2(56.01,43.68)
